# EasyEDA Pro project Cerberus_Power&Servo_V01_Test.eprj, board Cerberus_Power&amp;Servo_V01_Test
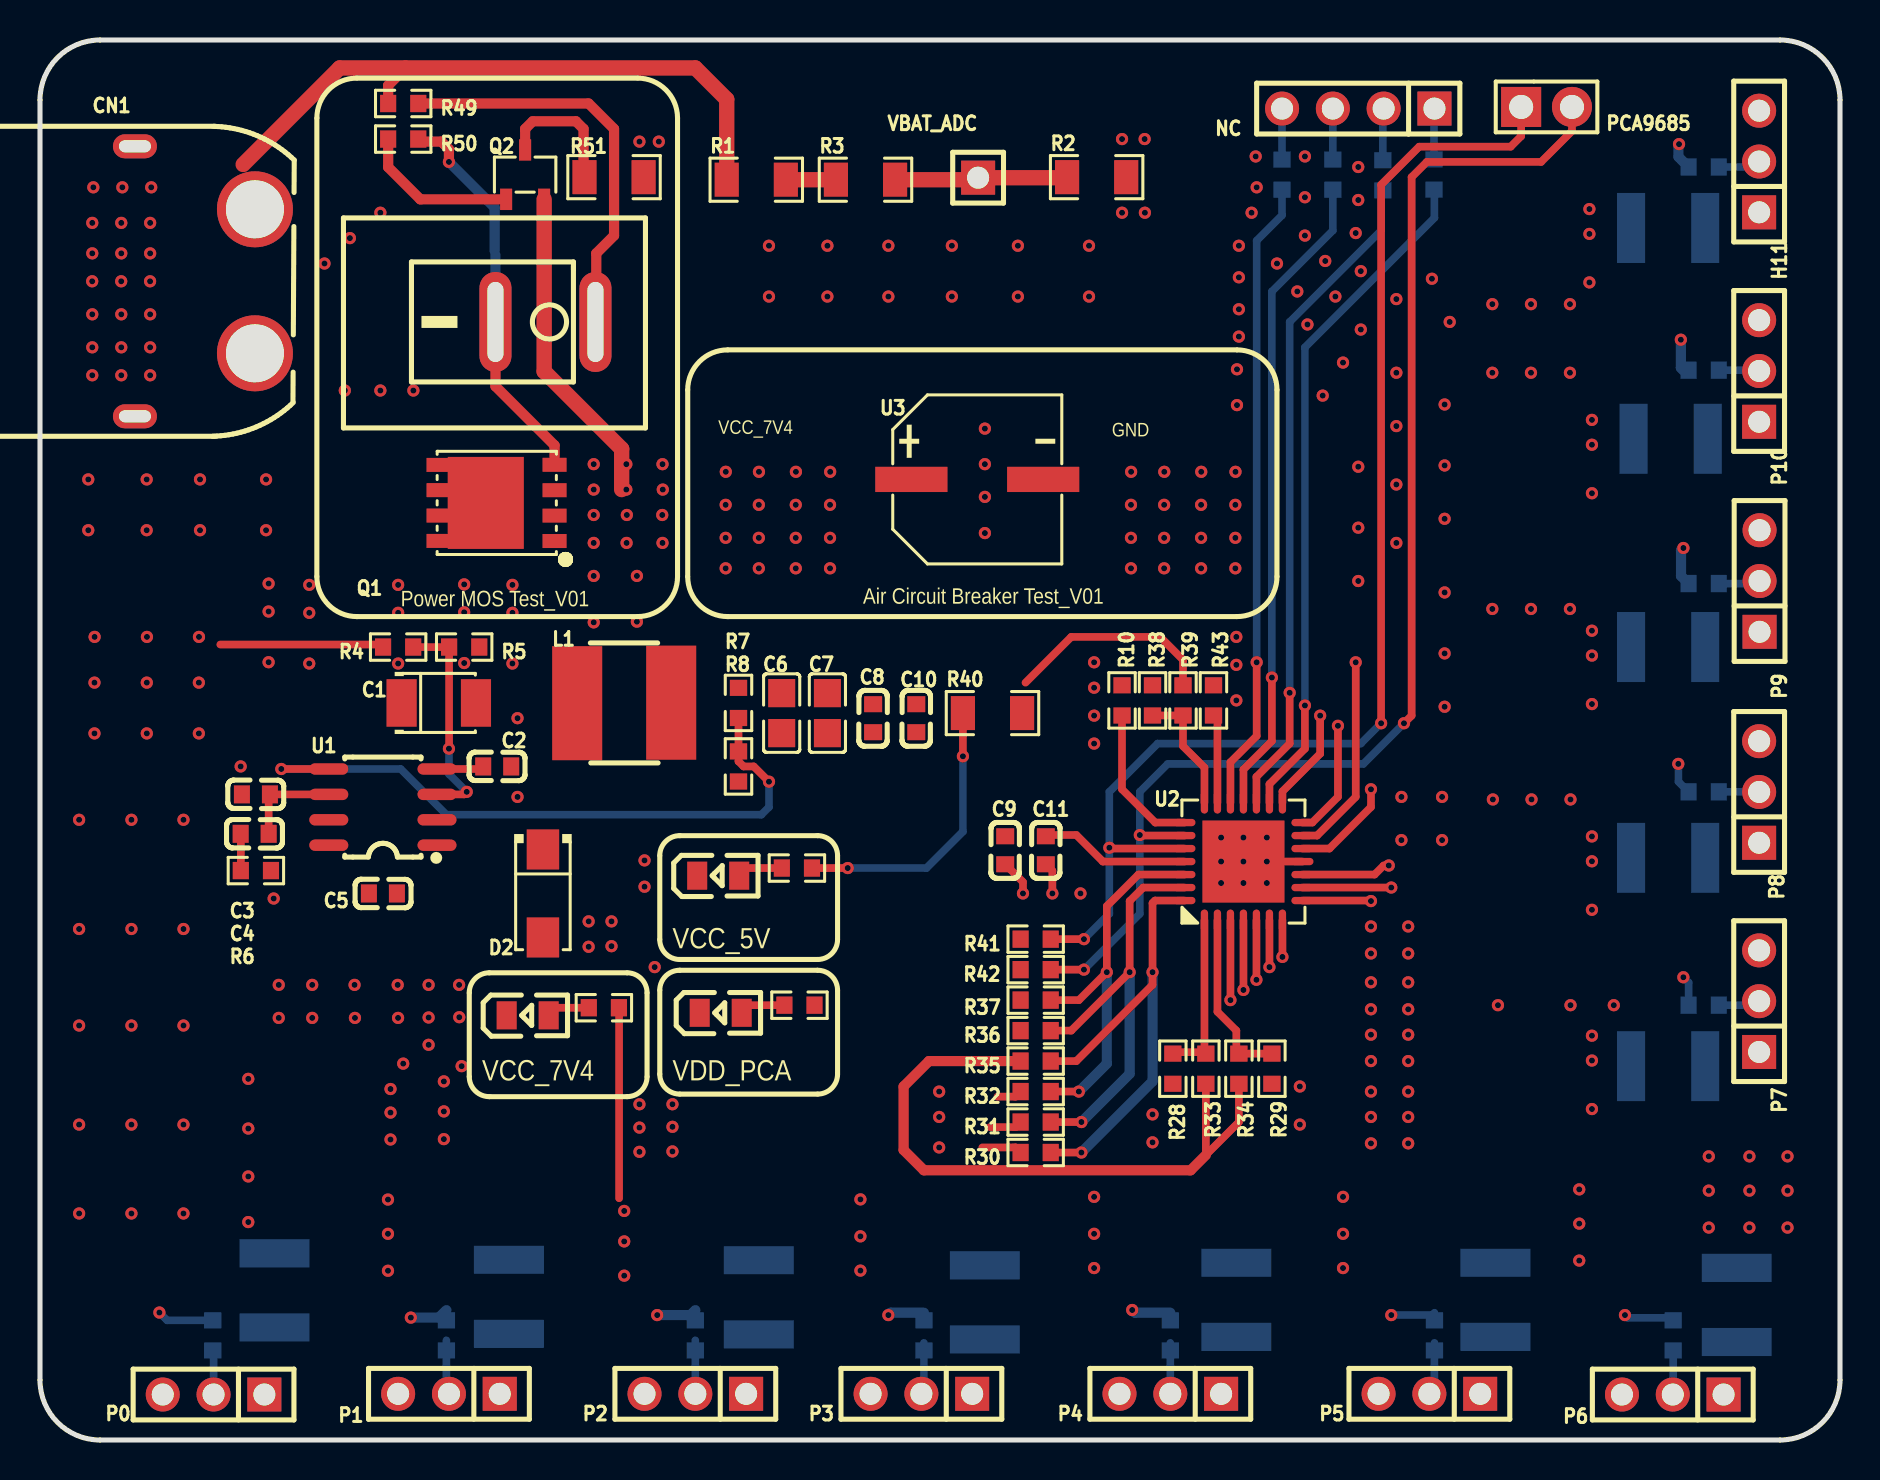
[diagram p3: board, top side]
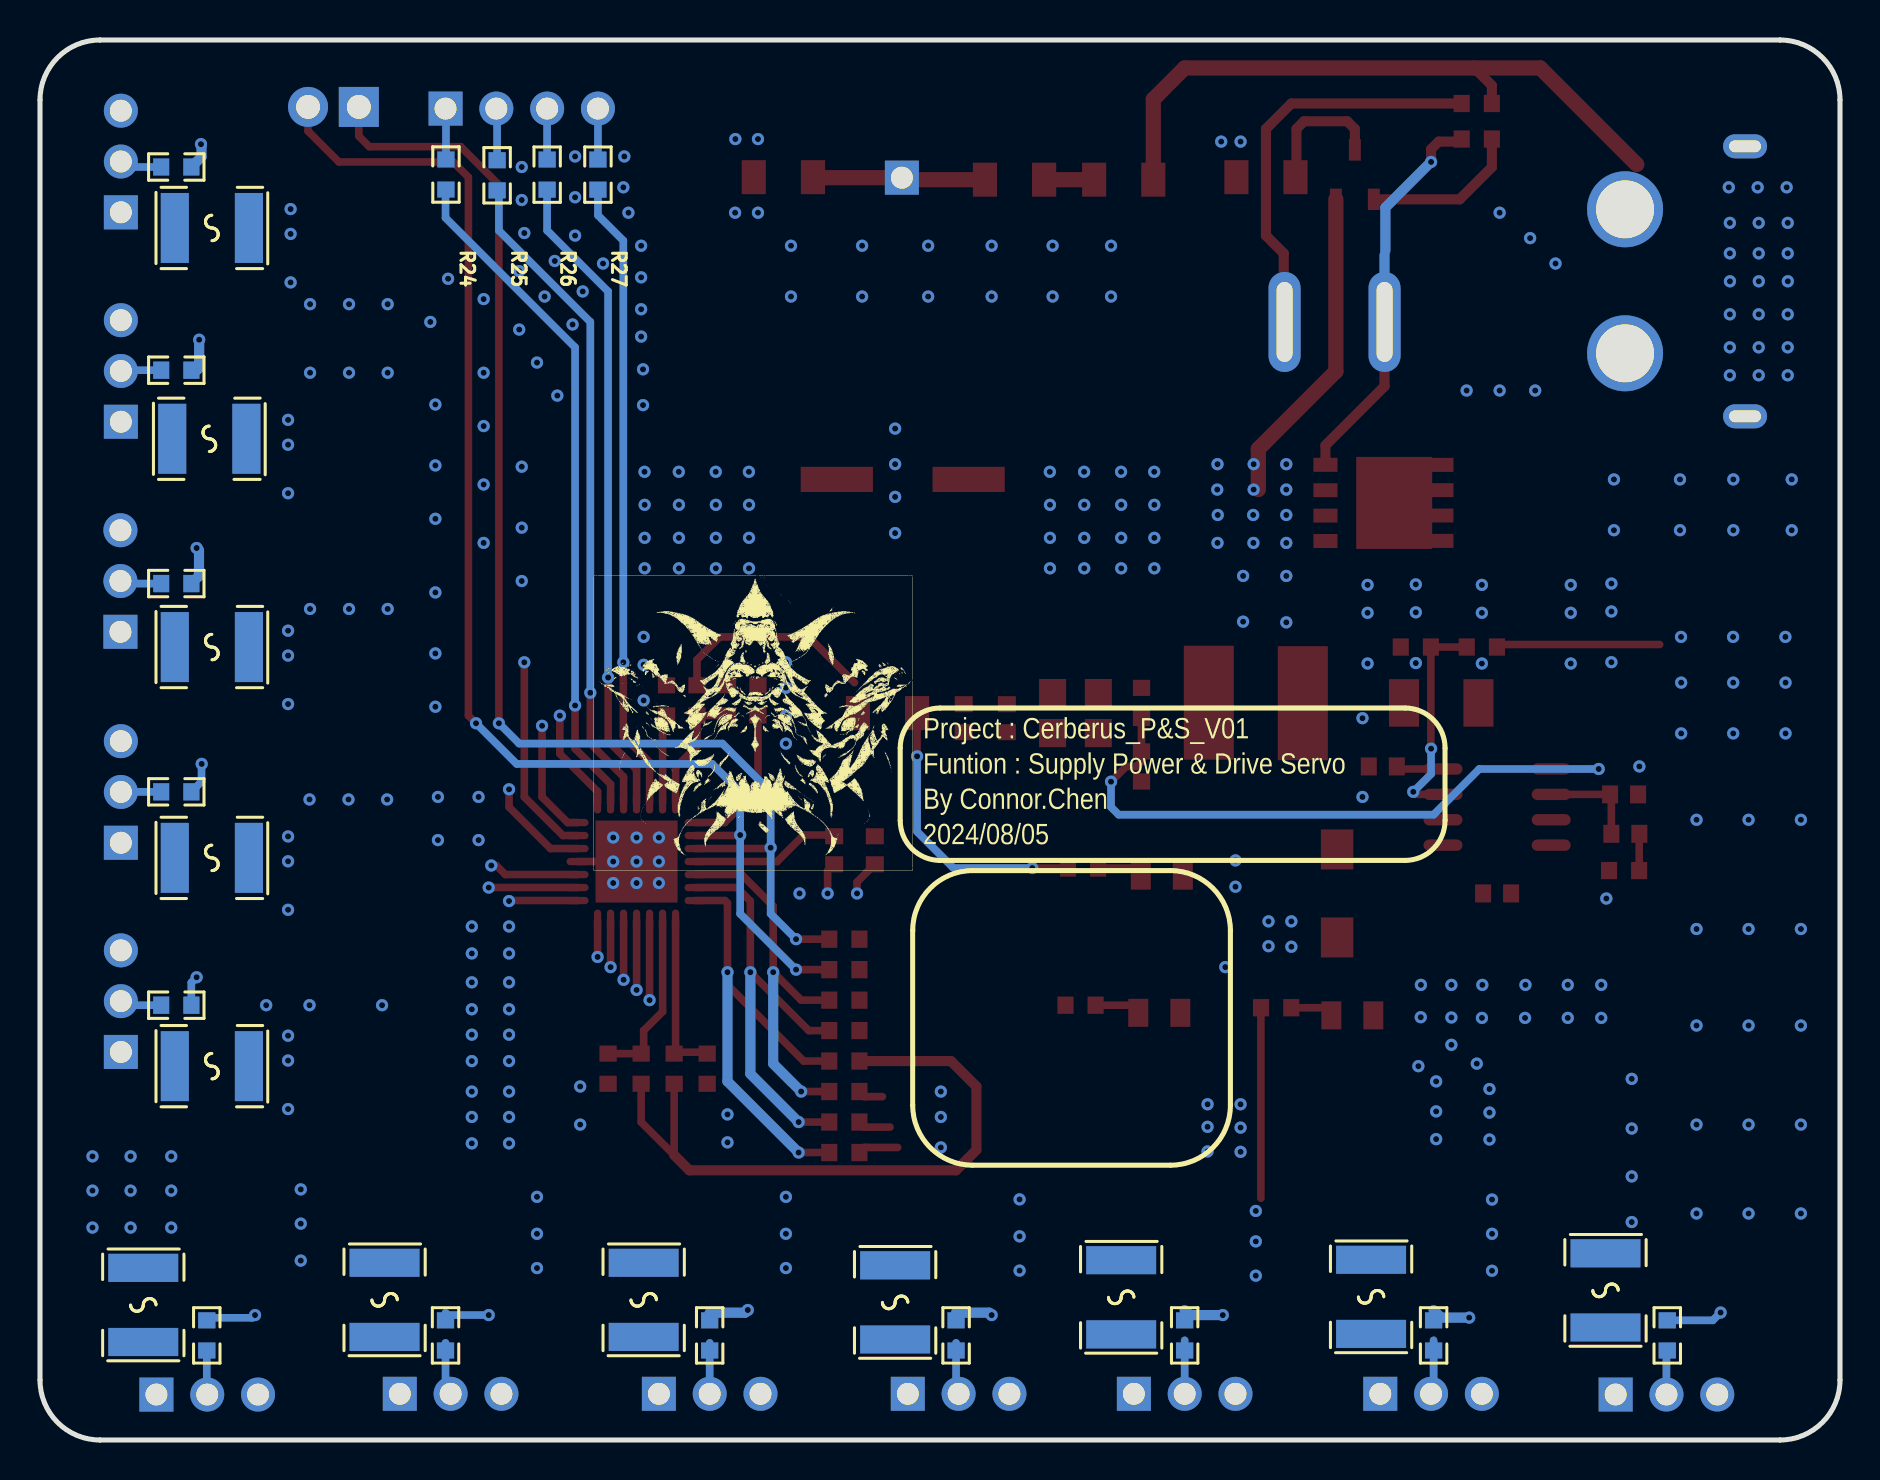
[diagram p4: board, bottom side, seen from below]

Outline 90 x 70 mm; copper layers: Top Layer, Inner1, Inner2, Bottom Layer. Coordinates in mm from the lower left corner of the outline.
Outline path: 0,67 0,3 arc(0.88,0.88) 3,0 87,0 arc(89.12,0.88) 90,3 90,67 arc(89.12,69.12) 87,70 3,70 arc(0.88,69.12) 0,67
Stack: Top Layer 0.035mm 外层铜厚1oz / Dielectric1 0.2104mm 7628 RC49% 8.6mil / Inner1 0.0152mm 内层铜厚 / Dielectric2 1.065mm 1.1mm H/HOZ 含铜 / Inner2 0.0152mm 内层铜厚 / Dielectric3 0.2104mm 7628 RC49% 8.6mil / Bottom Layer 0.035mm 外层铜厚1oz

## Design rules (mm)
template: 自定义配置
spacing copperThickness1oz (default): track to track 0.102, other pairs 0.152 to 0.3
spacing copperThickness2oz: track to track 0.203, other pairs 0.152 to 0.3
track width copperThickness1oz (default): min 0.127, default 0.254, max 2.54
track width copperThickness2oz: min 0.203, default 0.254, max 2.54
differential pair differentialPair (default): width min 0.127, default 0.254, max 2.54; gap min 0.152, default 0.152
via viaSize (default): diameter min 0.5, default 0.61, max 10; hole min 0.3, default 0.305, max 6.299
net GND uses innerPlane1, 全铺，隔离

## Placement (name value [footprint] x y rotation side)
C1  22uF  [CASE-B_3528]  19.94 36.85 0 top
C2  8.2nF  [C0603]  22.86 33.68 0 top
C3  10pF  [C0603]  10.8 32.28 0 top
C4  1nF  [C0603]  10.73 30.31 0 top
C5  100nF  [C0603]  17.14 27.33 180 top
C6  47uF  [C0805]  37.08 36.34 90 top
C7  47uF  [C0805]  39.37 36.34 90 top
C8  NC  [C0603]  41.66 36.09 90 top
C9  NC  [C0603]  48.26 29.49 90 top
C10  2.2uF  [C0603]  43.82 36.09 90 top
C11  100nF  [C0603]  50.29 29.49 90 top
CN1  XT60PW-M  [CONN-TH_XT60PW-M]  7.75 57.94 0 top
D2  SS24A  [SMA_L4.4-W2.6-LS5.1-FD]  25.15 27.33 90 top
F1  BSMD1812-200-16V  [F1812]  11.73 7.48 270 bottom
F2  BSMD1812-200-16V  [F1812]  23.45 7.16 270 bottom
F3  BSMD1812-200-16V  [F1812]  35.94 7.13 270 bottom
F4  BSMD1812-200-16V  [F1812]  47.24 6.88 270 bottom
F5  BSMD1812-200-16V  [F1812]  59.82 7.01 270 bottom
F6  BSMD1812-200-16V  [F1812]  72.77 7.01 270 bottom
F7  BSMD1812-200-16V  [F1812]  84.84 6.75 270 bottom
F8  BSMD1812-200-16V  [F1812]  81.41 18.69 0 bottom
F9  BSMD1812-200-16V  [F1812]  81.41 29.11 0 bottom
F10  BSMD1812-200-16V  [F1812]  81.41 39.65 0 bottom
F11  BSMD1812-200-16V  [F1812]  81.53 50.06 0 bottom
F12  BSMD1812-200-16V  [F1812]  81.41 60.6 0 bottom
H11  PZ254V-11-03P  [HDR-TH_3P-P2.54-V-M]  85.96 63.92 90 top
L1  4.5uH  [IND-SMD_L6.0-W6.0_FNR60XXS]  29.21 36.85 0 top
LED1  NCD0805R1  [LED0805-R-RD]  33.91 28.22 0 top
LED2  NCD0805R1  [LED0805-R-RD]  34.04 21.36 0 top
LED3  NCD0805R1  [LED0805-R-RD]  24.38 21.23 0 top
NC  PZ254V-11-04P  [HDR-TH_4P-P2.54-V-M]  65.91 66.57 180 top
P0  PZ254V-11-03P  [HDR-TH_3P-P2.54-V-M]  8.68 2.27 180 top
P1  PZ254V-11-03P  [HDR-TH_3P-P2.54-V-M]  20.45 2.31 180 top
P2  PZ254V-11-03P  [HDR-TH_3P-P2.54-V-M]  32.77 2.31 180 top
P3  PZ254V-11-03P  [HDR-TH_3P-P2.54-V-M]  44.07 2.31 180 top
P4  PZ254V-11-03P  [HDR-TH_3P-P2.54-V-M]  56.52 2.31 180 top
P5  PZ254V-11-03P  [HDR-TH_3P-P2.54-V-M]  69.47 2.31 180 top
P6  PZ254V-11-03P  [HDR-TH_3P-P2.54-V-M]  81.64 2.27 180 top
P7  PZ254V-11-03P  [HDR-TH_3P-P2.54-V-M]  85.96 21.94 90 top
P8  PZ254V-11-03P  [HDR-TH_3P-P2.54-V-M]  85.96 32.4 90 top
P9  PZ254V-11-03P  [HDR-TH_3P-P2.54-V-M]  85.98 42.95 90 top
P10  PZ254V-11-03P  [HDR-TH_3P-P2.54-V-M]  85.96 53.45 90 top
PCA9685  PZ254V-11-02P  [HDR-TH_2P-P2.54-V-M]  75.33 66.65 0 top
Q1  CJAC80SN10  [PDFN-8_L5.8-W5.0-P1.27-LS6.0-BL]  22.83 46.85 90 top
Q2  SI2305  [SOT-23-3_L2.9-W1.6-P1.90-LS2.8-BR]  24.26 63.27 270 top
R1  6.2kΩ  [R1206]  35.81 63.02 0 top
R2  10kΩ  [R1206]  52.83 63.14 0 top
R3  200Ω  [R1206]  41.27 63.02 0 top
R4  10kΩ  [R0603]  17.91 39.65 180 top
R5  10kΩ  [R0603]  21.21 39.65 180 top
R6  66.5kΩ  [R0603]  10.8 28.47 180 top
R7  10kΩ  [R0603]  34.92 36.85 90 top
R8  1.91kΩ  [R0603]  34.92 33.68 90 top
R10  0Ω  [R0603]  54.1 36.98 90 top
R12  220Ω  [R0603]  8.64 5.23 90 bottom
R13  220Ω  [R0603]  20.32 5.23 90 bottom
R14  220Ω  [R0603]  32.77 5.23 90 bottom
R15  220Ω  [R0603]  44.2 5.23 90 bottom
R16  220Ω  [R0603]  56.52 5.23 90 bottom
R17  220Ω  [R0603]  69.72 5.23 90 bottom
R18  220Ω  [R0603]  81.66 5.23 90 bottom
R19  220Ω  [R0603]  83.18 21.74 180 bottom
R20  220Ω  [R0603]  83.18 32.41 180 bottom
R21  220Ω  [R0603]  83.18 42.82 180 bottom
R22  220Ω  [R0603]  83.18 53.49 180 bottom
R23  220Ω  [R0603]  83.18 63.65 0 bottom
R24  220Ω  [R0603]  69.7 63.28 90 bottom
R25  220Ω  [R0603]  67.14 63.23 90 bottom
R26  220Ω  [R0603]  64.64 63.27 90 bottom
R27  220Ω  [R0603]  62.1 63.27 90 bottom
R28  10kΩ  [R0603]  56.64 18.56 90 top
R29  10kΩ  [R0603]  61.6 18.56 90 top
R30  10kΩ  [R0603]  49.78 14.37 180 top
R31  10kΩ  [R0603]  49.78 15.9 180 top
R32  10kΩ  [R0603]  49.78 17.42 180 top
R33  NC  [R0603]  58.29 18.56 90 top
R34  NC  [R0603]  59.94 18.56 90 top
R35  NC  [R0603]  49.78 18.95 180 top
R36  NC  [R0603]  49.78 20.47 180 top
R37  NC  [R0603]  49.78 21.99 180 top
R38  10kΩ  [R0603]  55.63 36.98 90 top
R39  NC  [R0603]  57.15 36.98 90 top
R40  0Ω  [R1206]  47.63 36.34 0 top
R41  4.7kΩ  [R0603]  49.78 25.04 180 top
R42  4.7kΩ  [R0603]  49.78 23.52 180 top
R43  1kΩ  [R0603]  58.67 36.98 90 top
R45  220Ω  [R0603]  37.97 21.74 180 top
R47  1kΩ  [R0603]  37.85 28.6 180 top
R48  2kΩ  [R0603]  28.19 21.61 180 top
R49  10kΩ  [R0603]  18.16 66.83 0 top
R50  10kΩ  [R0603]  18.16 65.05 180 top
R51  10kΩ  [R1206]  28.7 63.14 180 top
SW1  KCD11-2P-R  [SW-TH_2P-L15.0-W10.5-P5.00_KCD11-2P-R]  25.27 55.9 180 top
U1  TPS54331DR  [SOIC-8_L5.0-W4.0-P1.27-LS6.0-BL]  17.14 31.65 90 top
U2  PCA9685BS,118  [QFN-28_L6.0-W6.0-P0.65-TL-EP4.1]  60.17 28.92 90 top
U3  220uF  [CAP-SMD_BD8.0-L8.3-W8.3-LS9.1-FD]  46.86 48.03 0 top
VBAT_ADC  PZ254V-11-01P  [HDR-TH_1P-P2.54-V-M]  46.91 63.12 0 top

## Footprints (pads in the part's own frame, mm; a bottom-side part is the same pattern mirrored in y, then rotated)
C0603
  rect 0.8x0.9 smd: 1(-0.7,0) 2(0.7,0)
C0805
  rect 1.41x1.35 smd: 1(-1,0) 2(1,0)
CAP-SMD_BD8.0-L8.3-W8.3-LS9.1-FD
  rect 3.61x1.26 smd: 1(-3.295,0) 2(3.295,0)
CASE-B_3528
  rect 1.506x2.376 smd: 1(-1.861,0) 2(1.861,0)
CONN-TH_XT60PW-M
  round 3.8 hole 2.9: 1(3,-3.6) 2(3,3.6)
  oval 2.2x1.2 hole 1.6x0.6: 3(-3,6.75) 4(-3,-6.75)
F1812
  rect 1.407x3.499 smd: 1(-1.853,0) 2(1.853,0)
HDR-TH_1P-P2.54-V-M
  rect 1.7x1.7 hole 1.1: 1(0,0)
HDR-TH_2P-P2.54-V-M
  rect 2x2 hole 1.2: 1(-1.27,0)
  round 2 hole 1.2: 2(1.27,0)
HDR-TH_3P-P2.54-V-M
  rect 1.7x1.7 hole 1.1: 1(-2.54,0)
  round 1.7 hole 1.1: 2(0,0) 3(2.54,0)
HDR-TH_4P-P2.54-V-M
  rect 1.7x1.7 hole 1.1: 1(-3.81,0)
  round 1.7 hole 1.1: 2(-1.27,0) 3(1.27,0) 4(3.81,0)
IND-SMD_L6.0-W6.0_FNR60XXS
  rect 2.5x5.7 smd: 1(-2.35,-0.013) 2(2.35,0.013)
LED0805-R-RD
  rect 1x1.399 smd: 1(1.05,0) 2(-1.05,0)
PDFN-8_L5.8-W5.0-P1.27-LS6.0-BL
  rect 0.7x1.2 smd: 1(-1.905,-2.9) 2(-0.635,-2.9) 3(0.635,-2.9) 4(1.905,-2.9) 5(1.9,2.9) 6(0.64,2.9) 7(-0.63,2.9) 8(-1.9,2.9)
  rect 4.6x3.8 smd: 9(0,0.54)
QFN-28_L6.0-W6.0-P0.65-TL-EP4.1
  oval 1.1x0.364 smd: 1(-2.95,1.95) 2(-2.95,1.3) 3(-2.95,0.65) 4(-2.95,0) 5(-2.95,-0.65) 6(-2.95,-1.3) 7(-2.95,-1.95) 15(2.95,-1.95) 16(2.95,-1.3) 17(2.95,-0.65) 18(2.95,0) 19(2.95,0.65) 20(2.95,1.3) 21(2.95,1.95)
  oval 0.364x1.1 smd: 8(-1.95,-2.95) 9(-1.3,-2.95) 10(-0.65,-2.95) 11(0,-2.95) 12(0.65,-2.95) 13(1.3,-2.95) 14(1.95,-2.95) 22(1.95,2.95) 23(1.3,2.95) 24(0.65,2.95) 25(0,2.95) 26(-0.65,2.95) 27(-1.3,2.95) 28(-1.95,2.95)
  rect 4.1x4.1 smd: 29(0,0)
R0603
  rect 0.806x0.864 smd: 1(-0.753,0) 2(0.753,0)
R1206
  rect 1.208x1.701 smd: 1(-1.479,0) 2(1.479,0)
SMA_L4.4-W2.6-LS5.1-FD
  rect 2x1.62 smd: 1(-2.2,0) 2(2.2,0)
SOIC-8_L5.0-W4.0-P1.27-LS6.0-BL
  oval 0.569x1.95 smd: 1(-1.905,-2.705) 2(-0.635,-2.705) 3(0.635,-2.705) 4(1.905,-2.705) 5(1.905,2.705) 6(0.635,2.705) 7(-0.635,2.705) 8(-1.905,2.705)
SOT-23-3_L2.9-W1.6-P1.90-LS2.8-BR
  rect 1.07x0.6 smd: 1(1.235,-0.95) 2(1.235,0.95) 3(-1.235,0)
SW-TH_2P-L15.0-W10.5-P5.00_KCD11-2P-R
  oval 1.6x5 hole 0.8x4: 1(-2.5,0) 2(2.5,0)

## Nets
GND: C1.2 C2.2 C3.1 C6.1 C7.1 C8.1 C9.1 C10.1 C11.1 CN1.1 CN1.3 CN1.4 D2.1 H11.3 LED1.2 LED2.2 LED3.2 P0.3 P1.3 P2.3 P3.3 P4.3 P5.3 P6.3 P7.3 P8.3 P9.3 P10.3 R2.2 R5.1 R6.1 R8.1 R10.2 R28.1 R29.1 R30.2 R31.2 R32.2 R38.2 R43.2 R51.1 U1.7 U2.11 U2.29 U3.2
VBAT: CN1.2 Q1.5 Q1.6 Q1.7 Q1.8 Q1.9 R1.1 R49.1
VCC_5V: C6.2 C7.2 C8.2 C10.2 L1.2 R7.2 R40.1 R47.1
VCC_7V4: C1.1 F1.1 F2.1 F3.1 F4.1 F5.1 F6.1 F7.1 F8.1 F9.1 F10.1 F11.1 F12.1 Q1.1 Q1.2 Q1.3 Q2.2 R4.2 R48.1 U1.2 U3.1
VDD_PCA: C9.2 C11.2 R33.1 R34.1 R35.2 R36.2 R37.2 R39.2 R40.2 R41.2 R42.2 R45.1 U2.25
ADC_VBAT: R2.1 R3.2 VBAT_ADC.1
PCA_PWM0: P0.2 R12.1
PCA_PWM1: P1.2 R13.1
PCA_PWM2: P2.2 R14.1
PCA_PWM3: P3.2 R15.1
PCA_PWM4: P4.2 R16.1
PCA_PWM5: P5.2 R17.1
PCA_PWM6: P6.2 R18.1
PCA_PWM7: P7.2 R19.1
PCA_PWM8: P8.2 R20.1
PCA_PWM9: P9.2 R21.1
PCA_PWM10: P10.2 R22.1
PCA_PWM11: H11.2 R23.2
PCA_PWM12: NC.1 R24.2
PCA_PWM13: NC.2 R25.2
PCA_PWM14: NC.3 R26.2
PCA_PWM15: NC.4 R27.2
$1N560: R1.2 R3.1
$1N913: R4.1 R5.2 U1.3
$1N1409: C5.2 U1.8
$1N1671: C5.1 D2.2 L1.1 U1.1
$1N1830: R7.1 R8.2 U1.5
$1N2590: R49.2 SW1.1
$1N2606: Q1.4 R50.1 SW1.2
$1N3521: C2.1 U1.4
$1N3609: C3.2 C4.2 U1.6
$1N3610: C4.1 R6.2
$1N4187: Q2.1 R50.2
$1N4299: Q2.3 R51.2
$2N354: R10.1 U2.22
$2N1919: R12.2 U2.3
$2N1922: R13.2 U2.4
$2N1925: R14.2 U2.5
$2N1928: R15.2 U2.6
$2N1931: R16.2 U2.7
$2N1934: R17.2 U2.8
$2N1937: R18.2 U2.9
$2N1940: R19.2 U2.10
$2N1943: R20.2 U2.12
$2N1946: R21.2 U2.13
$2N1949: R22.2 U2.14
$2N1952: R23.1 U2.15
$2N1955: R24.1 U2.16
$2N1971: R25.1 U2.17
$2N1974: R26.1 U2.18
$2N1977: R27.1 U2.19
$2N2373: R28.2 R33.2 U2.1
$2N2387: R29.2 R34.2 U2.2
$2N2534: R30.1 R35.1 U2.28
$2N2543: R31.1 R36.1 U2.27
$2N2560: R32.1 R37.1 U2.26
$2N2720: R38.1 R39.1 U2.21
$2N3517: R43.1 U2.20
$2N5159: F1.2 P0.1
$2N5207: F2.2 P1.1
$2N5294: F4.2 P3.1
$2N5342: F3.2 P2.1
$2N5390: F5.2 P4.1
$2N5438: F6.2 P5.1
$2N5486: F7.2 P6.1
$2N5534: F8.2 P7.1
$2N5582: F9.2 P8.1
$2N5630: F10.2 P9.1
$2N5678: F11.2 P10.1
$2N5726: F12.2 H11.1
$2N7884: PCA9685.2 R42.1 U2.23
$2N7889: PCA9685.1 R41.1 U2.24
$4N386: LED2.1 R45.2
$4N862: LED1.1 R47.2
$4N975: LED3.1 R48.2

## Via types
v1: diameter 0.61, hole 0.305, Top Layer to Bottom Layer, 378 vias

## Routing (per net, layer and track width the routed paths; a pad name or vN(x,y) marks a point on that pad's centre or on a via; arc(x,y) is an arc through that point)
GND: length 10.1
  Top Layer w0.381: v1(49.15,27.33) 49.15,27.9 C9.1 ; R32.2 48.78,17.17 47.88,17.17 ; 47.5,15.64 48.78,15.64 R31.2 ; R30.2 48.78,14.63 47.12,14.63 ; v1(50.62,27.33) 50.62,28.46 C11.1 ; v1(61.34,28.92) U2.11
  vias: v1(2.41,48.03) v1(2.41,45.49) v1(2.61,60.86) v1(2.61,59.33) v1(2.61,57.94) v1(2.61,56.28) v1(2.61,54.63) v1(2.61,53.24) v1(2.67,62.63) v1(4.12,62.63) v1(4.06,60.86) v1(4.06,59.33) v1(4.06,57.94) v1(4.06,56.28) v1(4.06,54.63) v1(4.06,53.24) v1(5.33,48.03) v1(5.33,45.49) v1(5.51,60.86) v1(5.51,59.33) v1(5.5,57.94) v1(5.51,56.28) v1(5.51,54.63) v1(5.51,53.24) v1(5.56,62.63) v1(8,48.03) v1(8,45.49) v1(10.03,33.68) v1(11.3,48.03) v1(11.3,45.49) v1(11.68,27.07) v1(11.94,22.76) v1(11.94,21.11) v1(13.61,22.76) v1(13.61,21.11) v1(15.73,22.76) v1(15.75,21.11) v1(17.53,17.55) v1(17.53,16.37) v1(17.53,15.02) v1(17.88,22.76) v1(17.9,21.11) v1(18.16,18.82) v1(19.43,22.76) v1(19.43,21.13) v1(19.43,19.76) v1(20.19,17.93) v1(20.19,16.43) v1(20.19,15.04) v1(20.95,22.76) v1(20.96,21.14) v1(21.08,18.69) v1(23.88,36.09) v1(23.88,32.15) v1(27.43,25.93) v1(27.43,24.66) v1(28.58,25.93) v1(28.58,24.69) v1(29.97,64.92) v1(29.97,16.79) v1(29.97,15.62) v1(29.97,14.41) v1(30.23,28.98) v1(30.23,27.66) v1(30.73,23.64) v1(30.94,64.92) v1(31.62,16.79) v1(31.62,15.66) v1(31.62,14.43) v1(36.45,59.71) v1(36.45,57.17) v1(39.37,59.71) v1(39.37,57.17) v1(42.42,59.71) v1(42.42,57.17) v1(44.96,17.42) v1(44.96,16.15) v1(44.96,14.63) v1(45.59,59.71) v1(45.59,57.17) v1(47.24,50.57) v1(47.24,48.79) v1(47.24,47.16) v1(47.24,45.35) v1(48.89,59.71) v1(48.89,57.17) v1(52.02,27.33) v1(52.45,59.71) v1(52.45,57.17) v1(52.7,38.89) v1(52.7,37.62) v1(52.7,36.22) v1(52.7,34.82) v1(54.1,65.05) v1(54.1,61.36) v1(54.56,48.41) v1(54.55,46.76) v1(54.55,45.11) v1(54.55,43.58) v1(55.23,65.05) v1(55.24,61.36) v1(55.63,16.28) v1(55.63,14.88) v1(56.21,48.41) v1(56.21,46.76) v1(56.21,45.11) v1(56.21,43.58) v1(58.06,48.41) v1(58.05,46.76) v1(58.05,45.11) v1(58.05,43.58) v1(59.05,30.12) v1(59.05,28.92) v1(59.05,27.85) v1(59.77,48.41) v1(59.77,46.76) v1(59.77,45.11) v1(59.77,43.58) v1(59.82,40.16) v1(59.82,38.76) v1(59.82,36.98) v1(59.85,53.53) v1(59.85,51.74) v1(59.94,59.71) v1(59.94,58.13) v1(59.94,56.54) v1(59.94,55.17) v1(60.17,30.12) v1(60.17,28.92) v1(60.17,27.85) v1(60.58,61.36) v1(60.78,64.18) v1(60.83,62.63) v1(61.34,30.12) v1(61.34,27.85) v1(61.85,58.82) v1(62.86,57.43) v1(62.99,17.68) v1(62.99,15.77) v1(63.25,64.18) v1(63.25,62.14) v1(63.25,60.22) v1(63.37,55.78) v1(64.14,52.22) v1(64.26,58.95) v1(64.77,57.17) v1(65.15,53.87) v1(65.79,60.35) v1(65.91,63.65) v1(65.91,62) v1(65.91,48.66) v1(65.91,45.62) v1(65.91,42.95) v1(66.04,58.44) v1(66.04,55.52) v1(66.55,25.68) v1(66.55,24.33) v1(66.55,22.88) v1(66.55,21.54) v1(66.55,20.27) v1(66.55,18.95) v1(66.55,17.42) v1(66.55,16.15) v1(66.55,14.83) v1(67.82,57.05) v1(67.82,53.36) v1(67.82,50.7) v1(67.82,47.78) v1(67.82,44.85) v1(68.07,32.15) v1(68.07,30) v1(68.41,25.68) v1(68.41,24.33) v1(68.41,22.88) v1(68.41,21.54) v1(68.41,20.27) v1(68.41,18.95) v1(68.41,17.42) v1(68.41,16.15) v1(68.41,14.83) v1(69.6,58.06) v1(70.1,32.15) v1(70.1,30) v1(70.23,51.78) v1(70.23,48.73) v1(70.23,46.06) v1(70.23,42.38) v1(70.23,39.33) v1(70.23,36.66) v1(70.48,55.9)
VBAT: length 33
  Top Layer w0.508: R49.1 17.41,67.73 18.28,68.6
  Top Layer w0.762: 10.16,63.78 14.99,68.6 32.77,68.6 34.33,67.03 R1.1
  vias: v1(14.22,58.82) v1(15.24,52.47) v1(15.49,60.09) v1(17.02,61.36) v1(17.02,52.47) v1(18.67,52.47)
VCC_5V: length 14.2
  Top Layer w0.381: R47.1 v1(40.39,28.6) ; R40.1 v1(46.15,34.19)
  Bottom Layer w0.381: v1(46.15,34.19) 46.15,30.42 44.32,28.6 v1(40.39,28.6)
VCC_7V4: length 33.8
  Top Layer w0.381: R48.1 28.96,21.6 28.96,12.09 ; R4.2 17.03,39.77 9.02,39.77
  Top Layer w0.762: 29.08,47.52 29.08,49.55 25.21,53.43 Q2.2
  vias: v1(1.96,31.01) v1(1.96,25.55) v1(1.96,20.72) v1(1.96,15.77) v1(1.96,11.33) v1(2.73,40.16) v1(2.72,37.87) v1(2.72,35.33) v1(4.57,31.01) v1(4.57,25.55) v1(4.57,20.72) v1(4.57,15.77) v1(4.57,11.33) v1(5.35,40.16) v1(5.34,37.87) v1(5.34,35.33) v1(7.17,31.01) v1(7.17,25.55) v1(7.17,20.72) v1(7.17,15.77) v1(7.17,11.33) v1(7.95,40.16) v1(7.94,37.87) v1(7.94,35.33) v1(10.41,18.06) v1(10.41,15.57) v1(10.41,13.18) v1(10.41,10.9) v1(11.43,42.82) v1(11.43,41.42) v1(11.43,38.89) v1(13.46,42.76) v1(13.46,41.36) v1(13.46,38.82) v1(17.4,12.02) v1(17.4,10.31) v1(17.4,8.46) v1(17.91,42.76) v1(17.91,41.36) v1(17.91,38.82) v1(21.21,42.78) v1(21.21,41.38) v1(21.21,38.85) v1(23.62,42.76) v1(23.62,41.36) v1(23.62,38.82) v1(27.69,48.79) v1(27.69,47.52) v1(27.69,46.25) v1(27.69,44.85) v1(27.69,43.2) v1(27.69,40.88) v1(29.21,11.45) v1(29.21,9.93) v1(29.21,8.22) v1(29.32,48.79) v1(29.32,47.52) v1(29.33,44.85) v1(29.34,46.25) v1(29.85,43.2) v1(29.85,40.92) v1(31.13,48.79) v1(31.14,47.52) v1(31.11,46.25) v1(31.13,44.85) v1(34.29,48.41) v1(34.28,46.76) v1(34.28,45.11) v1(34.28,43.58) v1(35.95,48.41) v1(35.94,46.76) v1(35.94,45.11) v1(35.94,43.58) v1(37.8,48.41) v1(37.79,46.76) v1(37.79,45.11) v1(37.79,43.58) v1(39.51,48.41) v1(39.5,46.76) v1(39.5,45.11) v1(39.5,43.58) v1(41.02,12.03) v1(41.02,10.18) v1(41.02,8.47) v1(52.7,12.16) v1(52.7,10.31) v1(52.7,8.6) v1(65.15,12.16) v1(65.15,10.31) v1(65.15,8.6) v1(72.62,56.79) v1(72.62,53.36) v1(72.62,41.55) v1(72.64,32.03) v1(72.9,21.74) v1(74.55,56.79) v1(74.55,53.36) v1(74.55,41.55) v1(74.58,32.03) v1(76.5,56.79) v1(76.5,53.36) v1(76.5,41.55) v1(76.52,32.03) v1(76.52,21.74) v1(76.96,12.53) v1(76.96,10.82) v1(76.96,8.97) v1(77.47,61.55) v1(77.47,60.3) v1(77.47,57.88) v1(77.6,51.01) v1(77.6,49.76) v1(77.6,47.34) v1(77.6,40.47) v1(77.6,39.22) v1(77.6,36.8) v1(77.6,30.18) v1(77.6,28.94) v1(77.6,26.51) v1(77.6,20.22) v1(77.6,18.97) v1(77.6,16.55) v1(78.69,21.74) v1(83.44,14.18) v1(83.44,12.47) v1(83.44,10.62) v1(85.47,14.18) v1(85.47,12.47) v1(85.47,10.62) v1(87.38,14.18) v1(87.38,12.47) v1(87.38,10.62)
VDD_PCA: length 51.3
  Top Layer w0.381: 49.28,37.87 51.56,40.16 56.01,40.16 57.15,39.01 R39.2 ; R33.1 58.29,14.25 59.94,15.9 R34.1 ; U2.25 53.14,28.92 51.82,30.25 50.35,30.25 C11.2
  Top Layer w0.508: 58.29,14.25 57.53,13.48 44.2,13.48 43.18,14.5 43.18,17.68 44.45,18.95 R35.2
ADC_VBAT: length 8.7
  Top Layer w0.762: R3.2 46.8,63.02 VBAT_ADC.1 51.33,63.12 R2.1
PCA_PWM0: length 2.2
  Bottom Layer w0.381: P0.2 8.68,4.44 R12.1
PCA_PWM1: length 2.7
  Bottom Layer w0.381: 20.32,4.98 R13.1 20.32,2.44 P1.2
PCA_PWM2: length 2.7
  Bottom Layer w0.381: P2.2 R14.1 32.77,4.98
PCA_PWM3: length 2.6
  Bottom Layer w0.381: P3.2 44.2,2.44 44.2,4.86
PCA_PWM4: length 2.5
  Bottom Layer w0.381: 56.52,4.86 P4.2
PCA_PWM5: length 2.7
  Bottom Layer w0.381: P5.2 69.72,2.56 69.72,4.86
PCA_PWM6: length 2.3
  Bottom Layer w0.381: P6.2 81.66,2.3 81.66,4.6
PCA_PWM7: length 2.1
  Bottom Layer w0.381: R19.1 85.76,21.74 P7.2
PCA_PWM8: length 2
  Bottom Layer w0.381: R20.1 85.95,32.41 P8.2
PCA_PWM9: length 2.1
  Bottom Layer w0.381: P9.2 85.85,42.82 R21.1
PCA_PWM10: length 2
  Bottom Layer w0.381: P10.2 85.92,53.49 R22.1
PCA_PWM11: length 2.1
  Bottom Layer w0.381: H11.2 85.68,63.65 R23.2
PCA_PWM12: length 2.6
  Bottom Layer w0.381: NC.1 69.7,66.55 R24.2
PCA_PWM13: length 2.6
  Bottom Layer w0.381: R25.2 67.14,66.53 NC.2
PCA_PWM14: length 2.5
  Bottom Layer w0.381: R26.2 NC.3
PCA_PWM15: length 2.5
  Bottom Layer w0.381: R27.2 NC.4
$1N560: length 2.5
  Top Layer w0.762: R1.2 39.8,63.02
$1N913: length 10.9
  Top Layer w0.381: v1(20.45,34.57) 20.46,34.58 R5.2 R4.1 ; U1.3 21.21,32.28 v1(21.34,32.41)
  Bottom Layer w0.381: v1(21.34,32.41) 20.45,33.3 v1(20.45,34.57)
$1N1830: length 33.2
  Top Layer w0.381: v1(36.45,32.92) 35.69,33.68 35.18,33.68 34.92,33.93 R8.2 R7.1 ; U1.5 v1(12.06,33.55)
  Bottom Layer w0.381: v1(12.06,33.55) 18.03,33.55 20.32,31.27 36.07,31.27 36.45,31.65 v1(36.45,32.92)
$1N2590: length 20.4
  Top Layer w0.508: SW1.1 27.81,55.94 27.81,59.33 28.7,60.22 28.7,65.56 27.43,66.83 R49.2
$1N2606: length 19.5
  Top Layer w0.508: SW1.2 22.77,52.69 25.73,49.73 Q1.4 ; v1(20.45,63.9) 20.45,64.54 20.07,64.92 19.04,64.92 R50.1
  Bottom Layer w0.508: 22.77,59.25 SW1.2 ; 22.73,59.46 22.73,61.62 v1(20.45,63.9)
$1N3521: length 2.4
  Top Layer w0.381: U1.4 22.03,33.55 C2.1
$1N3609: length 4.9
  Top Layer w0.381: U1.6 C3.2 11.43,32.22 C4.2
$1N3610: length 1.8
  Top Layer w0.381: R6.2 10.04,30.3 C4.1
$1N4187: length 8
  Top Layer w0.508: R50.2 17.41,63.64 19.02,62.03 Q2.1
$1N4299: length 6.7
  Top Layer w0.508: Q2.3 24.26,65.56 24.64,65.94 26.8,65.94 27.18,65.56 27.18,63.19 R51.2
$2N354: length 7.5
  Top Layer w0.381: R10.1 54.1,32.53 55.76,30.87 U2.22
$2N1919: length 73.5
  Top Layer w0.381: U2.3 v1(59.52,21.99)
  Inner2 w0.381: v1(5.97,6.37) 5.97,17.68 10.29,21.99 v1(59.52,21.99)
  Bottom Layer w0.381: R12.2 6.36,5.98 v1(5.97,6.37)
$2N1922: length 61
  Top Layer w0.381: U2.4 v1(60.17,22.5)
  Inner2 w0.381: v1(60.17,22.5) 60.17,21.73 59.68,21.23 22.1,21.23 18.54,17.68 v1(18.54,6.12)
  Bottom Layer w0.508: v1(18.54,6.12) 19.95,6.12 20.32,6.49
$2N1925: length 49.5
  Top Layer w0.381: U2.5 v1(60.82,23.01)
  Inner2 w0.381: v1(30.86,6.25) 30.86,17.68 33.78,20.6 59.94,20.6 60.82,21.47 v1(60.82,23.01)
  Bottom Layer w0.508: v1(30.86,6.25) 32.52,6.25 32.77,6.49
$2N1928: length 39.3
  Top Layer w0.381: v1(61.47,23.64) U2.6
  Inner2 w0.381: v1(61.47,23.64) 61.47,21.36 60.07,19.96 43.31,19.96 42.42,19.07 v1(42.42,6.25)
  Bottom Layer w0.508: v1(42.42,6.25) 42.54,6.36 44.2,6.36
$2N1931: length 26.3
  Top Layer w0.381: U2.7 v1(62.12,24.15)
  Inner2 w0.381: v1(62.12,24.15) 62.12,21.12 60.45,19.45 57.42,19.45 54.61,16.64 v1(54.61,6.5)
  Bottom Layer w0.508: v1(54.61,6.5) 54.75,6.36 56.52,6.36
$2N1934: length 26.8
  Top Layer w0.381: U2.8 66.52,26.97 v1(66.55,26.95)
  Inner2 w0.381: v1(67.56,6.25) 67.56,25.93 v1(66.55,26.95)
  Bottom Layer w0.381: 69.72,6.36 69.6,6.25 v1(67.56,6.25)
$2N1937: length 34.6
  Top Layer w0.381: U2.9 v1(67.56,27.62)
  Inner2 w0.381: v1(67.56,27.62) 70.06,27.62 74.8,22.88 74.8,17.04 79.25,12.6 v1(79.25,6.25)
  Bottom Layer w0.381: 81.66,6.11 79.38,6.11 v1(79.25,6.25)
$2N1940: length 23.1
  Top Layer w0.381: U2.10 66.73,28.27 67.18,28.73 v1(67.44,28.73)
  Inner2 w0.381: v1(67.44,28.73) 72.01,28.73 77.6,23.14 v1(82.17,23.14)
  Bottom Layer w0.381: v1(82.17,23.14) 82.43,22.87 R19.2
$2N1943: length 22.7
  Top Layer w0.381: U2.12 64.47,29.57 66.55,31.65 v1(66.55,32.53)
  Inner2 w0.381: v1(81.92,33.81) 67.82,33.81 v1(66.55,32.53)
  Bottom Layer w0.381: R20.2 81.92,32.92 81.92,33.8 v1(81.92,33.81)
$2N1946: length 31.7
  Top Layer w0.381: U2.13 63.85,30.22 65.79,32.15 v1(65.79,38.89)
  Inner2 w0.381: v1(82.17,44.6) 70.23,44.6 65.79,40.16 v1(65.79,38.89)
  Bottom Layer w0.508: R21.2 82.05,43.2 82.05,44.48 v1(82.17,44.6)
$2N1949: length 40.8
  Top Layer w0.381: U2.14 63.62,30.87 64.9,32.15 v1(64.9,35.71)
  Inner2 w0.381: v1(64.9,35.71) 64.9,49.3 70.61,55.01 v1(82.04,55.01)
  Bottom Layer w0.508: R22.2 82.16,53.49 82.04,53.61 v1(82.04,55.01)
$2N1952: length 44.6
  Top Layer w0.381: U2.15 62.12,32.43 64.01,34.31 v1(64.01,36.22)
  Inner2 w0.381: v1(64.01,36.22) 64.01,50.7 78.11,64.79 81.79,64.79
  Bottom Layer w0.508: v1(81.95,64.79) 81.92,64.77 81.92,64.16 R23.1
$2N1955: length 34.1
  Top Layer w0.381: v1(63.25,36.73) 63.25,34.57 61.47,32.79 U2.16
  Bottom Layer w0.381: R24.1 69.72,62.5 69.72,61.11 63.25,54.63 v1(63.25,36.73)
$2N1971: length 33.2
  Top Layer w0.381: v1(62.48,37.36) 62.48,34.82 60.82,33.16 U2.17
  Bottom Layer w0.381: R25.1 67.06,62.39 67.06,60.48 62.48,55.9 v1(62.48,37.36)
$2N1974: length 32.5
  Top Layer w0.381: v1(61.6,38.12) 61.6,34.95 60.17,33.52 U2.18
  Bottom Layer w0.381: v1(61.6,38.12) 61.6,57.43 64.64,60.48 R26.1
$2N1977: length 31.7
  Top Layer w0.381: U2.19 59.52,33.89 60.83,35.2 v1(60.83,38.89)
  Bottom Layer w0.381: v1(60.83,38.89) 60.83,59.97 62.1,61.24 R27.1
$2N2373: length 8.3
  Top Layer w0.381: 58.22,19.39 56.71,19.39 R28.2 ; 58.22,19.39 U2.1 ; 58.22,19.39 R33.2
$2N2387: length 8.7
  Top Layer w0.381: R29.2 R34.2 59.82,19.45 59.82,20.47 58.87,21.42 U2.2
$2N2534: length 24.4
  Top Layer w0.381: v1(52.07,14.37) R30.1 ; U2.28 55.75,26.97 55.63,26.85 v1(55.63,23.39) 55.63,22.76 51.82,18.95 R35.1
  Bottom Layer w0.508: v1(55.63,23.39) 55.63,17.93 v1(52.07,14.37)
$2N2543: length 21.8
  Top Layer w0.381: U2.27 55.16,27.62 54.48,26.95 v1(54.48,23.39) 51.56,20.47 R36.1 ; v1(52.07,15.9) R31.1
  Bottom Layer w0.508: v1(54.48,23.39) 54.48,18.31 v1(52.07,15.9)
$2N2560: length 19.2
  Top Layer w0.381: U2.26 54.92,28.27 53.34,26.69 v1(53.34,23.39) 51.94,21.99 R37.1 ; v1(51.94,17.42) R32.1
  Bottom Layer w0.508: v1(51.94,17.42) 53.34,18.82 v1(53.34,23.39)
$2N2720: length 6.3
  Top Layer w0.381: R38.1 R39.1 57.15,34.69 58.22,33.62 U2.21
$2N3517: length 4.4
  Top Layer w0.381: R43.1 58.87,36.03 U2.20
$2N7884: length 66.2
  Top Layer w0.381: U2.23 55.02,30.22 v1(54.99,30.25) ; v1(68.2,35.84) 68.58,36.22 68.58,63.14 69.34,63.9 75.06,63.9 76.6,65.45 PCA9685.2 ; R42.1 v1(52.2,23.52)
  Bottom Layer w0.381: v1(52.2,23.52) 54.99,26.31 v1(54.99,30.25) 54.99,32.41 56.39,33.81 66.17,33.81 v1(68.2,35.84)
$2N7889: length 64.7
  Top Layer w0.381: PCA9685.1 74.06,65.19 73.53,64.67 68.96,64.67 67.06,62.76 v1(67.06,35.84) ; R41.1 v1(52.2,25.04) ; v1(53.47,29.61) 53.51,29.57 U2.24
  Bottom Layer w0.381: v1(52.2,25.04) 53.47,26.31 v1(53.47,29.61) 53.47,32.41 55.88,34.82 66.04,34.82 v1(67.06,35.84)
$4N386: length 2.3
  Top Layer w0.381: R45.2 35.47,21.74 LED2.1
$4N862: length 2.3
  Top Layer w0.381: R47.2 35.34,28.6 LED1.1
$4N975: length 2.2
  Top Layer w0.381: R48.2 25.82,21.61 LED3.1

## Copper pours and planes (outline as drawn; the poured copper is in the pictures)
GND on Top Layer: 53.28,49 53.29,49.17 53.35,49.37 53.44,49.55 53.57,49.7 53.73,49.83 53.91,49.93 54.1,49.98 54.28,50 60.28,50 60.45,49.98 60.65,49.93 60.83,49.83 60.98,49.7 61.11,49.55 61.21,49.37 61.26,49.17 61.28,49 61.28,43 61.26,42.82 61.21,42.63 61.11,42.45 60.98,42.29 60.83,42.16 60.65,42.07 60.45,42.01 60.28,42 54.28,42 54.1,42.01 53.91,42.07 53.73,42.16 53.57,42.29 53.44,42.45 53.35,42.63 53.29,42.82 53.28,43
GND on Top Layer: 11.56,57.17 12.95,55.78 12.95,52.47 11.68,51.2 7.67,51.2 6.65,50.19 2.67,50.19 1.4,51.46 1.4,66.19 1.91,66.7 6.22,66.7 6.6,66.32 6.6,57.68 7.11,57.17
GND on Top Layer: -7.75,78.76 95.89,78.76 95.89,-5.44 -7.75,-5.44
GND on Bottom Layer: -7.75,78.76 95.89,78.76 95.89,-5.44 -7.75,-5.44
GND on Bottom Layer: 11.49,57.17 12.89,55.78 12.89,52.48 11.62,51.21 7.6,51.21 6.58,50.19 2.61,50.19 1.33,51.46 1.33,66.19 1.84,66.7 6.16,66.7 6.54,66.32 6.54,57.68 7.05,57.17
GND on Inner1: 0.26,69.74 89.74,69.74 89.74,0.26 0.26,0.26
GND on Inner2: 11.49,57.17 12.89,55.78 12.89,52.48 11.62,51.21 7.6,51.21 6.58,50.19 2.61,50.19 1.33,51.46 1.33,66.19 1.84,66.7 6.16,66.7 6.54,66.32 6.54,57.68 7.05,57.17
VBAT on Top Layer: 8.51,63.03 9.89,64.41 15.09,64.41 19.56,59.94 19.56,50.7 21.34,48.92 21.34,45.11 20.83,44.6 16.76,44.6 14.22,47.14 14.22,57.05 12.45,58.82 9.65,58.82 8.51,59.97
VBAT on Bottom Layer: 13.08,58.44 13.08,61.46 13.84,62.23 17.3,62.23 19.6,59.93 19.6,52.01 18.8,51.2 15.24,51.2 14.22,52.22 14.22,57.3
VBAT on Inner2: 8.45,63.03 9.83,64.41 15.15,64.41 19.62,59.94 19.62,50.7 21.4,48.92 21.4,45.11 20.89,44.6 16.83,44.6 14.29,47.14 14.29,57.05 12.51,58.82 9.59,58.82 8.45,59.97
VCC_5V on Top Layer: 29.72,39.77 30.48,40.54 47.12,40.54 47.75,39.9 47.75,35.33 47.24,34.82 45.47,34.82 44.96,35.33 44.96,35.96 44.58,36.34 36.13,36.34 35.62,36.85 34.16,36.85 33.66,36.34 33.66,33.93 33.27,33.55 30.23,33.55 29.72,34.06
VCC_7V4 on Top Layer: 87.76,15.52 88.39,14.88 88.39,8.53 86.99,7.13 79.38,7.13 78.87,7.64 78.87,14.63 79.76,15.52
VCC_7V4 on Top Layer: 11.41,8.03 11.67,8.03 12.57,7.13 79.72,7.13 81.66,9.07 81.66,13.87 80.01,15.52 75.06,15.52 72.52,12.98 17.91,12.98 14.48,16.41 11.94,16.41 11.41,15.88
VCC_7V4 on Top Layer: 2.03,42.57 8.64,42.57 9.78,41.42 9.78,34.82 8.76,33.81 1.4,33.81 0.76,34.44 0.76,41.3
VCC_7V4 on Top Layer: 9.4,39.1 10.17,38.33 19.03,38.33 19.43,37.93 19.43,35.59 19.03,35.19 10.15,35.19 9.4,34.44
VCC_7V4 on Top Layer: 32.77,49 32.78,49.17 32.84,49.37 32.93,49.55 33.06,49.7 33.22,49.83 33.4,49.93 33.59,49.98 33.77,50 39.77,50 39.94,49.98 40.14,49.93 40.32,49.83 40.47,49.7 40.6,49.55 40.69,49.37 40.75,49.17 40.77,49 40.77,43 40.75,42.82 40.69,42.63 40.6,42.45 40.47,42.29 40.32,42.16 40.14,42.07 39.94,42.01 39.77,42 33.77,42 33.59,42.01 33.4,42.07 33.22,42.16 33.06,42.29 32.93,42.45 32.84,42.63 32.78,42.82 32.77,43
VCC_7V4 on Top Layer: 0.76,35.08 0.76,9.67 3.3,7.13 13.46,7.13 15.88,9.55 15.88,15.14 8.38,22.63 8.38,33.68 9.27,34.57 9.27,35.33 1.02,35.33
VCC_7V4 on Top Layer: 18.97,31.54 20.81,31.54 21.08,31.27 21.08,30.76 20.83,30.5 17.4,30.5 16.64,31.27 16.64,34.57 16,35.2 16,35.84 18.92,35.84 19.3,35.46 18.29,34.44 18.29,31.77 18.54,31.52 18.95,31.52
VCC_7V4 on Top Layer: 45.21,50.31 45.85,49.68 45.85,47.27 45.08,46.5 40.51,46.5 40.13,46.89 40.13,49.94 40.51,50.31
VCC_7V4 on Top Layer: 27.43,50.31 40.51,50.31 41.15,49.68 41.15,42.19 40.64,41.68 27.81,41.68 24.89,44.6 24.89,47.78
VCC_7V4 on Top Layer: 68.33,12.85 71.65,16.17 71.65,61 72.9,62.25 80.33,62.25 81.41,61.17 81.41,13.74 80.52,12.85
VCC_7V4 on Bottom Layer: 76.96,20.98 80.14,20.98 80.77,20.34 80.77,16.41 80.14,15.77 77.09,15.77 76.2,16.66 76.2,20.22
VCC_7V4 on Bottom Layer: 23.37,43.71 24.57,44.91 24.57,48.21 26.67,50.31 33.66,50.31 33.66,44.45 32.77,43.56 23.52,43.56
VCC_7V4 on Bottom Layer: 68.33,12.85 71.65,16.17 71.65,61 72.9,62.25 80.33,62.25 81.41,61.17 81.41,13.74 80.52,12.85
VCC_7V4 on Bottom Layer: 11.41,8.03 11.67,8.03 12.57,7.13 79.72,7.13 81.66,9.07 81.66,13.87 80.01,15.52 75.06,15.52 72.52,12.98 17.91,12.98 14.48,16.41 11.94,16.41 11.41,15.88
VCC_7V4 on Bottom Layer: 83.4,7.16 82.42,8.13 82.42,15.12 83.06,15.75 87.5,15.75 88.27,14.99 88.27,7.88 87.54,7.16
VCC_7V4 on Bottom Layer: 33.59,11.88 34.57,12.85 41.55,12.85 42.19,12.22 42.19,7.77 41.42,7.01 34.31,7.01 33.59,7.73
VCC_7V4 on Bottom Layer: 77.22,52.06 80.39,52.06 81.03,51.43 81.03,47.49 80.39,46.86 77.34,46.86 76.45,47.74 76.45,51.3
VCC_7V4 on Bottom Layer: 57.55,12.13 58.53,13.1 65.51,13.1 66.15,12.47 66.15,8.02 65.38,7.26 58.27,7.26 57.55,7.98
VCC_7V4 on Bottom Layer: 33.02,50.31 40.39,50.31 41.15,49.55 41.15,42.19 36.07,37.11 10.54,37.11 9.78,36.34 9.78,34.82 8.76,33.81 1.52,33.81 0.89,34.44 0.89,41.92 2.68,43.71 30.92,43.71
VCC_7V4 on Bottom Layer: 77.09,31.16 80.26,31.16 80.9,30.53 80.9,26.59 80.26,25.95 77.22,25.95 76.33,26.84 76.33,30.4
VCC_7V4 on Bottom Layer: 45.11,12.13 46.08,13.1 53.07,13.1 53.7,12.47 53.7,8.02 52.94,7.26 45.83,7.26 45.11,7.98
VCC_7V4 on Bottom Layer: 77.09,41.55 80.26,41.55 80.9,40.92 80.9,36.98 80.26,36.35 77.22,36.35 76.33,37.24 76.33,40.79
VCC_7V4 on Bottom Layer: 21.31,11.9 22.29,12.87 29.27,12.87 29.91,12.24 29.91,7.79 29.15,7.03 22.03,7.03 21.31,7.75
VCC_7V4 on Bottom Layer: 0.83,34.95 0.83,9.55 3.37,7.01 13.53,7.01 15.94,9.42 15.94,15.01 8.45,22.5 8.45,33.55 9.33,34.44 9.33,35.2 1.08,35.2
VCC_7V4 on Bottom Layer: 9.69,12.13 10.67,13.1 17.65,13.1 18.29,12.47 18.29,8.02 17.53,7.26 10.41,7.26 9.69,7.98
VCC_7V4 on Bottom Layer: 70.12,12.13 71.1,13.1 78.08,13.1 78.72,12.47 78.72,8.02 77.96,7.26 70.85,7.26 70.12,7.98
VCC_7V4 on Bottom Layer: 77.09,62.54 80.26,62.54 80.9,61.91 80.9,57.97 80.26,57.33 77.22,57.33 76.33,58.22 76.33,61.78
VCC_7V4 on Inner2: 33.08,50.19 40.45,50.19 41.21,49.43 41.21,42.06 36.13,36.98 10.6,36.98 9.84,36.22 9.84,34.69 8.83,33.68 1.59,33.68 0.95,34.31 0.95,41.79 2.74,43.58 30.98,43.58
VCC_7V4 on Inner2: 23.43,43.66 24.63,44.86 24.63,48.16 26.73,50.26 33.72,50.26 33.72,44.4 32.83,43.51 23.58,43.51
VDD_PCA on Top Layer: 48.13,37.36 49.02,38.25 50.8,38.25 51.31,37.74 51.31,29.79 51,29.48 47.51,29.48 46.99,30 46.99,33.3 48.13,34.44
VDD_PCA on Top Layer: 49.32,26.19 49.78,25.72 49.78,18.56 49.53,18.31 47.5,18.31 46.61,19.2 46.61,20.6 46.23,20.98 38.29,20.98 38.04,21.23 38.04,22.44 38.35,22.76 46.1,22.76 46.61,23.26 46.61,25.72 47.07,26.19
VDD_PCA on Top Layer: 40.39,22.63 42.55,24.79 42.55,32.03 44.2,33.68 47.5,33.68 47.5,22.75 46.75,21.99 40.43,21.99 40.39,22.04
$1N1409 on Top Layer: 13.08,30 13.46,30.38 15.24,30.38 15.88,29.74 15.88,28.23 16.06,28.04 16.94,28.04 17.14,27.84 17.14,26.44 16.89,26.19 13.72,26.19 13.08,26.82
$1N1671 on Top Layer: 17.35,29.7 17.91,30.25 23.37,30.25 24.89,31.77 24.89,39.77 25.53,40.41 28.39,40.41 29.2,39.6 29.2,30.11 26.04,26.95 20.07,26.95 19.3,26.19 17.87,26.19 17.35,26.7
$2N5159 on Bottom Layer: 14.14,1.8 13.63,1.29 10.27,1.29 9.74,1.82 9.74,6.04 10.33,6.63 13.75,6.63 14.14,6.25
$2N5207 on Bottom Layer: 25.82,1.67 25.31,1.17 21.95,1.17 21.42,1.7 21.42,5.92 22.01,6.5 25.44,6.5 25.82,6.12
$2N5294 on Bottom Layer: 49.57,1.55 49.06,1.04 45.7,1.04 45.17,1.57 45.17,5.79 45.76,6.37 49.19,6.37 49.57,5.99
$2N5342 on Bottom Layer: 38.27,1.67 37.76,1.17 34.4,1.17 33.87,1.7 33.87,5.92 34.45,6.5 37.88,6.5 38.27,6.12
$2N5390 on Bottom Layer: 61.97,1.42 61.46,0.91 58.1,0.91 57.57,1.44 57.57,5.66 58.16,6.25 61.59,6.25 61.97,5.87
$2N5438 on Bottom Layer: 75.1,1.55 74.59,1.04 71.23,1.04 70.7,1.57 70.7,5.79 71.29,6.37 74.71,6.37 75.1,5.99
$2N5486 on Bottom Layer: 87.14,1.38 86.63,0.88 83.27,0.88 82.75,1.41 82.75,5.63 83.33,6.21 86.76,6.21 87.14,5.83
$2N5534 on Bottom Layer: 86.85,20.85 87.35,20.34 87.35,17.87 85.94,16.45 82.6,16.45 82.02,17.04 82.02,20.47 82.4,20.85
$2N5582 on Bottom Layer: 86.85,31.01 87.35,30.5 87.35,28.03 85.94,26.62 82.6,26.62 82.02,27.2 82.02,30.63 82.4,31.01
$2N5630 on Bottom Layer: 86.99,41.59 87.5,41.08 87.5,38.61 86.08,37.2 82.75,37.2 82.17,37.78 82.17,41.21 82.55,41.59
$2N5678 on Bottom Layer: 87.12,52 87.63,51.5 87.63,49.03 86.21,47.61 82.88,47.61 82.3,48.19 82.3,51.62 82.68,52
$2N5726 on Bottom Layer: 86.87,62.63 87.38,62.13 87.38,59.66 85.96,58.24 82.63,58.24 82.04,58.82 82.04,62.25 82.42,62.63

Small or netless copper shapes (teardrops, artwork), in the pictures only: 1 on Top Layer

## Text on the board
Bottom Silkscreen Layer: Project : Cerberus_P&S_V01 / Funtion : Supply Power & Drive Servo / By Connor.Chen / 2024/08/05
Top Silkscreen Layer: VCC_7V4 | GND | Power MOS Test_V01 | Air Circuit Breaker Test_V01 | VCC_5V | VDD_PCA
